# EasyEDA Pro project Example_3D Shell Design.eprj, board 3D Shell Example-B (continued)
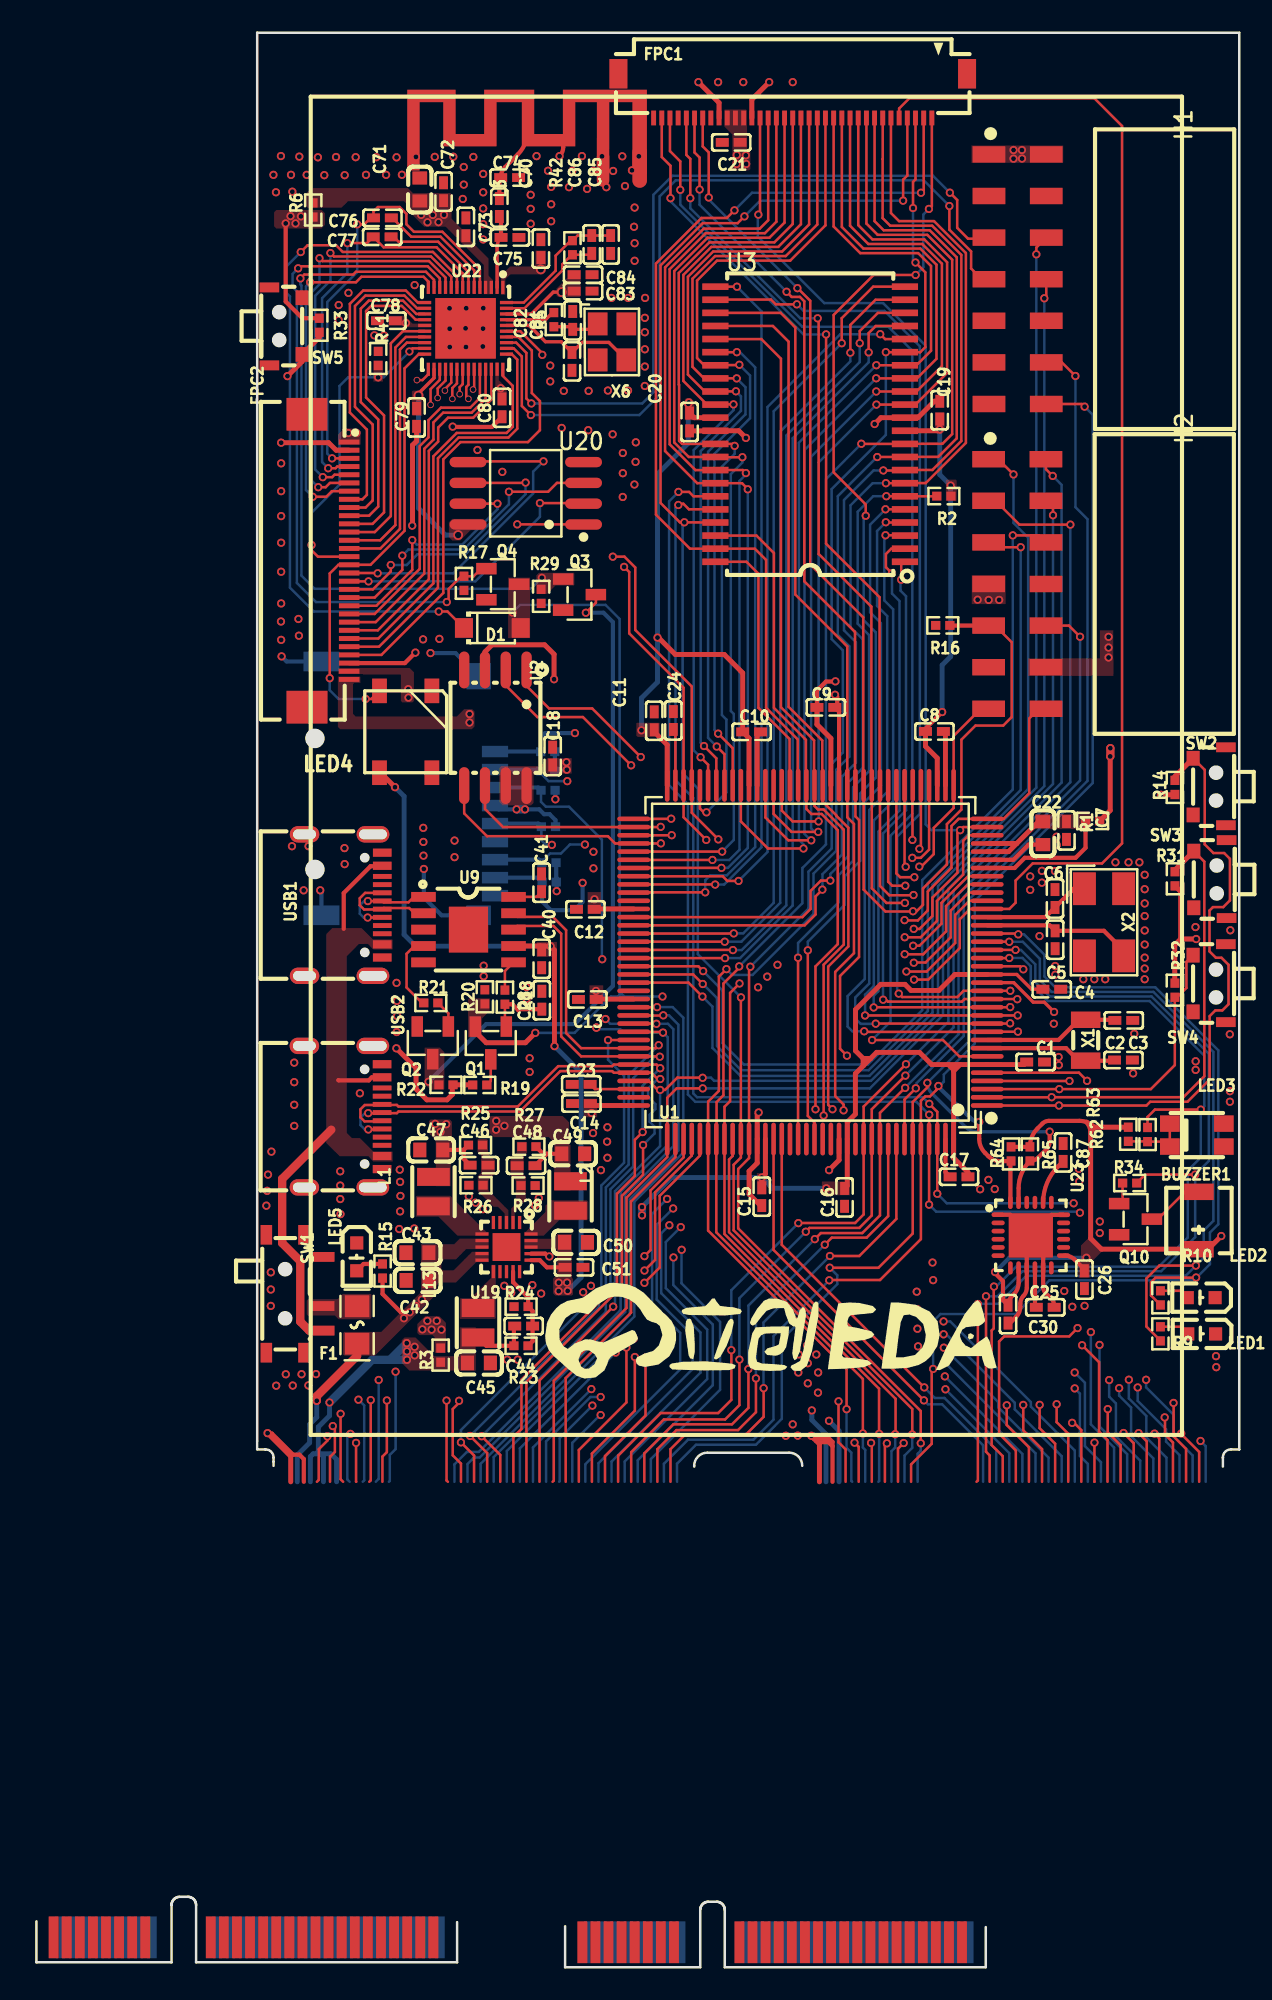
[diagram p0: board, top side]
## Routing (per net, layer and track width the routed paths; a pad name or vN(x,y) marks a point on that pad's centre or on a via; arc(x,y) is an arc through that point) (continued)
FSMC-A17: length 105.9
  Top Layer w0.152: U1.81 36.49,66.11 41.46,66.11 v1(41.47,66.11) ; U3.23 42.8,102.61 v1(42.8,102.61)
  Inner1 w0.152: v1(55.42,38.65) 55.45,38.62 55.51,38.62 55.87,38.98 55.87,54.66 54.71,55.82 54.71,69.16 54.27,69.6 52.76,69.6 52.28,69.12 52.28,67.35 49.02,64.1 44.4,64.1 42.39,66.11 v1(41.47,66.11)
  Bottom Layer w0.152: v1(41.47,66.11) 42.01,66.11 44.3,68.39 44.3,101.11 v1(42.8,102.61) ; v1(55.42,38.65) 55.59,38.65 59.77,34.46 59.77,34.07 62.64,31.2 62.64,29.64
FSMC-A18: length 102.4
  Top Layer w0.152: 41.48,98.61 v1(42.79,98.61) ; v1(40.86,65.63) 36.5,65.63 U1.82
  Inner1 w0.152: v1(40.86,65.63) 42.47,65.63 44.28,63.82 49.14,63.82 52.56,67.24 52.56,68.98 52.9,69.32 54.15,69.32 54.43,69.04 54.43,55.57 55.6,54.4 55.6,39.61 v1(55.42,39.43)
  Bottom Layer w0.152: 63.44,29.64 63.44,31.55 60.75,34.23 60.75,34.51 55.83,39.43 v1(55.42,39.43) ; v1(42.79,98.61) 42.98,98.61 43.91,97.68 43.91,68.4 42.19,66.67 41.16,66.67 40.86,66.37 v1(40.86,65.63)
FSMC-D0: length 125.8
  Top Layer w0.152: FPC1.6 52.21,107.11 52.7,106.61 54.84,106.61 56.78,104.67 56.78,93.07 54.33,90.62 53.08,90.62 ; U1.85 46.8,64.12 47.3,64.62 47.3,65.72 47.93,66.35 v1(48.5,66.35) ; U3.7 v1(51.9,90.61)
  Inner1 w0.152: v1(63.43,35.34) 63.88,35.79 63.88,37.21 61.27,39.82 61.27,50.08 60.73,50.62 60.73,59.42 59.69,60.46 57.96,60.46 57.16,61.26 57.16,69.73 55.6,71.3 51.99,71.3 50.6,69.9 50.6,68.44 v1(48.5,66.35)
  Bottom Layer w0.152: 64.24,29.64 64.24,30.73 63.75,31.22 63.75,35.03 v1(63.43,35.34) ; v1(48.5,66.35) 48.5,66.75 49.59,67.84 49.59,72.33 50.48,73.23 50.48,81.08 49.74,81.83 49.74,89.26 51.09,90.61 v1(51.9,90.61)
FSMC-D1: length 126.9
  Top Layer w0.152: v1(51.74,91.39) 51.73,91.4 51.74,91.39 53.03,91.38 U3.8 ; FPC1.7 51.71,110.41 51.7,110.4 51.7,106.8 52.16,106.34 54.72,106.34 56.51,104.55 56.51,93.19 54.74,91.42 53.08,91.42 ; U1.86 46.94,63.62 47.6,64.28 47.6,65.38 v1(48.02,65.8)
  Inner1 w0.152: v1(63.43,36.32) 63.43,37.22 60.99,39.65 60.99,49.95 60.45,50.49 60.45,59.31 59.58,60.18 57.82,60.18 56.89,61.12 56.89,69.62 55.48,71.02 52.2,71.02 50.88,69.7 50.88,68 48.67,65.8 v1(48.02,65.8)
  Bottom Layer w0.152: v1(51.74,91.39) 51.14,91.39 49.34,89.59 49.34,81.63 50.06,80.9 50.06,73.55 49.21,72.69 49.21,67.93 48.02,66.74 48.02,65.8 v1(48.02,65.8) ; 65.04,29.64 65.04,30.84 64.06,31.82 64.06,35.69 v1(63.43,36.32)
FSMC-D2: length 101.1
  Top Layer w0.152: U3.9 51.37,92.21 v1(51.37,92.21) ; v1(49.5,34.07) 49.5,36.52 41.04,44.98 U1.114 41.04,52.85 41.69,53.51 41.69,60.48 v1(42.16,60.94) ; 53.08,92.22 55.09,92.22 56.23,93.35 56.23,104.41 54.58,106.06 51.76,106.06 51.21,106.61 FPC1.8
  Bottom Layer w0.152: v1(42.16,60.94) 42.51,60.59 43.76,60.59 47.48,64.31 47.48,66.78 48.87,68.17 48.87,73.12 49.67,73.92 49.67,80.65 48.96,81.36 48.96,89.82 51.35,92.21 v1(51.37,92.21) ; v1(49.5,34.07) 49.5,31.71 49.79,31.42 49.79,29.69 49.84,29.64
FSMC-D3: length 99.9
  Top Layer w0.152: 42.94,61.12 42.94,61.03 41.97,60.07 41.97,53.24 41.56,52.82 41.56,50.59 U1.115 41.54,44.87 50.49,35.92 v1(50.49,32.59) ; 42.94,61.12 42.93,61.12 ; 42.94,61.12 42.94,61.13 42.93,61.12 ; 42.93,61.12 42.89,61.16 ; 53.06,93.01 50.41,93.01 v1(50.4,93.02) ; 53.08,93.02 55.35,93.02 55.95,93.61 55.95,104.26 54.43,105.78 51.4,105.78 50.71,106.47 FPC1.9
  Bottom Layer w0.152: v1(42.94,61.11) 46.8,64.97 46.8,67.12 48.24,68.56 48.24,90.86 v1(50.4,93.02) ; 50.64,29.64 50.64,31.59 50.49,31.73 v1(50.49,32.59)
FSMC-D4: length 121.6
  Top Layer w0.152: FPC1.10 50.21,106.37 51.08,105.5 54.25,105.5 55.64,104.11 55.64,97.35 53.71,95.42 53.08,95.42 ; v1(51.32,95.41) U3.13 ; v1(47.78,69.96) 46.2,69.96 45.54,70.62 U1.58
  Inner1 w0.152: v1(47.78,69.96) 47.97,70.15 47.97,70.83 50.95,73.81 64.67,73.81 70.22,68.26 70.22,33.03 v1(71.12,32.13)
  Bottom Layer w0.152: 47.79,69.92 47.79,69.96 ; 47.79,69.96 v1(47.78,69.96) ; 47.79,69.96 47.79,91.88 v1(51.32,95.41) ; 71.44,29.64 71.44,31.82 v1(71.12,32.13)
FSMC-D5: length 123.5
  Top Layer w0.152: v1(47.76,69.32) 46.13,69.32 45.04,70.42 U1.59 ; 53.08,96.22 53.78,96.22 55.32,97.76 55.32,104.02 54.12,105.22 50.82,105.22 49.71,106.33 FPC1.11 ; U3.14 v1(51.31,96.21) ; v1(69.94,32.59) 69.94,32.56 71.04,31.46 71.04,29.64
  Inner1 w0.152: v1(69.94,32.59) 69.94,68.14 64.55,73.53 51.07,73.53 48.25,70.71 48.25,69.66 47.92,69.32 v1(47.76,69.32)
  Bottom Layer w0.152: v1(47.76,69.32) 47.75,69.33 47.53,69.33 47.33,69.54 47.33,92.23 v1(51.31,96.21)
FSMC-D6: length 124.6
  Top Layer w0.152: U3.15 51.31,97.02 v1(51.31,97.02) ; FPC1.12 49.21,106.26 50.52,104.94 54,104.94 54.99,103.95 54.99,98.21 53.8,97.02 53.08,97.02 ; v1(69.47,34.46) 69.48,34.45 69.48,32.41 70.24,31.65 70.24,29.64 ; 44.54,72.17 44.54,70.21 45.93,68.81 v1(47.34,68.81)
  Inner1 w0.152: v1(69.47,34.46) 69.48,34.46 69.48,34.85 69.66,35.03 69.66,68.03 64.44,73.25 51.18,73.25 48.53,70.6 48.53,69.45 47.89,68.81 v1(47.34,68.81)
  Bottom Layer w0.152: v1(47.34,68.81) 47.32,68.81 46.93,69.2 46.93,92.64 v1(51.31,97.02)
FSMC-D7: length 126.7
  Top Layer w0.152: v1(46.86,68.31) 44.69,68.31 43.04,69.96 43.04,72.17 ; FPC1.13 48.71,106.28 50.33,104.66 53.87,104.66 54.65,103.88 54.65,98.7 53.77,97.82 53.08,97.82 ; U3.16 51.32,97.82 ; v1(68.93,33.57) 68.95,33.55 68.95,32.53 69.44,32.04 69.44,29.64
  Inner1 w0.152: v1(46.86,68.31) 47.78,68.31 48.81,69.33 48.81,70.48 51.3,72.97 64.32,72.97 69.38,67.91 69.38,35.15 68.95,34.71 68.95,33.59 v1(68.93,33.57)
  Bottom Layer w0.152: 46.86,68.3 46.88,68.28 46.88,68.55 46.58,68.84 46.58,93.09 v1(51.31,97.82)
FSMC-D8: length 126.9
  Top Layer w0.152: 41.49,97.82 U3.29 ; 41.49,97.82 41.49,97.83 ; 41.49,97.82 40.79,97.82 40.36,98.25 40.36,102.98 41.58,104.2 46.05,104.2 48.21,106.36 FPC1.14 ; 68.64,29.64 68.6,29.68 68.6,32.29 v1(68.31,32.58) ; 41.5,97.82 41.49,97.83 ; 41.49,97.83 42.96,97.83 v1(42.94,97.84) ; v1(41.65,75.32) 42.54,74.43 U1.64
  Inner1 w0.152: v1(41.65,75.32) 42.54,74.43 42.54,70.38 45.07,67.86 47.73,67.86 49.09,69.22 49.09,70.37 51.41,72.69 64.14,72.69 69.09,67.74 69.09,35.25 68.31,34.47 v1(68.31,32.58)
  Bottom Layer w0.152: v1(42.94,97.84) 43.6,97.19 43.6,94.58 41.42,92.41 41.42,75.55 v1(41.65,75.32)
FSMC-D9: length 126.4
  Top Layer w0.152: 41.48,97.02 40.78,97.02 40.08,97.72 40.08,103.1 41.46,104.48 45.78,104.48 47.71,106.41 FPC1.15 ; 41.48,97.02 41.5,97.02 ; 41.48,97.02 42.94,97.02 42.95,97.02 42.95,97.01 v1(42.78,97.01) ; 67.84,29.64 67.84,32.11 v1(67.34,32.61) ; v1(41.56,74.53) 42.04,74.06 U1.65
  Inner1 w0.152: v1(41.56,74.53) 42.04,74.06 42.04,70.49 44.95,67.58 47.84,67.58 49.37,69.1 49.37,70.25 51.53,72.41 64.03,72.41 68.82,67.63 68.82,35.37 67.34,33.89 v1(67.34,32.61)
  Bottom Layer w0.152: v1(41.56,74.53) 41.03,75.06 41.03,92.53 43.32,94.82 43.32,96.47 v1(42.78,97.01)
FSMC-D10: length 126.4
  Top Layer w0.152: 41.5,96.22 42.73,96.22 v1(42.74,96.23) ; FPC1.16 47.21,106.41 45.56,104.76 41.35,104.76 39.8,103.22 39.8,97.25 40.83,96.22 41.5,96.22 ; U1.66 41.54,73.82 v1(40.79,74.57) ; v1(66.42,32.62) 67.04,32 67.04,29.64
  Inner1 w0.152: v1(66.42,32.62) 66.42,33.36 68.54,35.48 68.54,67.51 63.91,72.14 51.64,72.14 49.65,70.14 49.65,68.99 47.96,67.3 44.84,67.3 41.76,70.37 41.76,73.24 41.54,73.46 41.54,73.81 v1(40.79,74.57)
  Bottom Layer w0.152: v1(40.79,74.57) 40.58,74.77 40.58,92.57 43.04,95.03 43.04,95.92 v1(42.74,96.23)
FSMC-D11: length 126.4
  Top Layer w0.152: FPC1.17 46.71,106.43 45.32,105.04 41.23,105.04 39.52,103.33 39.52,96.86 40.96,95.42 41.5,95.42 41.51,95.43 v1(42.59,95.43) ; v1(65.45,34.08) 65.45,32.66 66.24,31.88 66.24,29.64 ; U1.67 41.04,73.42 v1(40.58,73.88)
  Inner1 w0.152: v1(65.45,34.08) 65.48,34.05 66.67,34.05 68.26,35.64 68.26,67.39 63.79,71.86 51.76,71.86 49.92,70.02 49.92,68.87 48.07,67.02 44.72,67.02 41.48,70.26 41.48,73.01 40.61,73.88 v1(40.58,73.88)
  Bottom Layer w0.152: v1(40.58,73.88) 40.15,74.31 40.15,92.64 42.59,95.07 v1(42.59,95.43)
FSMC-D12: length 119.7
  Top Layer w0.152: v1(42.66,92.89) 42.54,93.01 39.45,93.01 39.26,93.2 39.26,96.62 39.24,96.64 39.24,103.45 41.12,105.32 45.09,105.32 46.21,106.44 FPC1.18 ; 65.44,29.64 65.44,32.19 64.92,32.71 64.92,36.94 v1(63.89,37.98) ; U1.68 40.54,70.75 40.77,70.51 40.93,70.51
  Inner1 w0.152: v1(40.94,70.52) 40.94,70.28 44.52,66.7 48.16,66.7 50.26,68.8 50.26,69.96 51.88,71.58 55.71,71.58 57.44,69.85 57.44,61.61 58.3,60.76 59.79,60.76 61.06,59.49 61.06,50.69 61.55,50.19 61.55,40.31 v1(63.89,37.98)
  Bottom Layer w0.152: v1(40.94,70.52) 42.15,71.73 42.15,76.18 41.88,76.46 41.88,91.62 42.66,92.4 v1(42.66,92.89)
FSMC-D13: length 121.1
  Top Layer w0.152: U1.77 41.89,68.12 v1(41.9,68.12) ; FPC1.19 45.71,106.53 44.78,105.6 41,105.6 38.97,103.56 38.97,93.1 39.85,92.21 U3.36 41.49,92.2 v1(43.13,92.2)
  Inner1 w0.152: v1(55.54,35.29) 56.99,36.74 56.99,55.12 55.96,56.15 55.96,67.85 55.94,67.87 55.94,69.51 54.71,70.74 52.32,70.74 51.16,69.58 51.16,67.89 48.48,65.21 45.48,65.21 42.57,68.12 v1(41.9,68.12)
  Bottom Layer w0.152: 59.44,29.64 59.44,31.39 v1(55.54,35.29) ; v1(43.13,92.2) 43.13,91.88 42.42,91.17 42.42,76.7 42.6,76.52 42.6,68.83 v1(41.9,68.12)
FSMC-D14: length 121.9
  Top Layer w0.152: v1(43.34,91.23) 43.16,91.42 41.48,91.42 U3.37 40.26,91.41 38.69,92.99 38.69,103.68 40.89,105.88 44.5,105.88 45.21,106.58 45.21,112.91 ; v1(41.3,67.61) 36.5,67.61 U1.78
  Inner1 w0.152: v1(41.3,67.61) 42.69,67.61 45.37,64.93 48.67,64.93 51.44,67.7 51.44,69.47 52.41,70.44 54.61,70.44 55.61,69.45 55.61,56.11 56.71,55 56.71,37.29 v1(55.5,36.08)
  Bottom Layer w0.152: 60.24,29.64 60.24,31.34 v1(55.5,36.08) ; v1(43.34,91.23) 43.34,91.14 42.95,90.75 42.95,68.23 42.33,67.61 v1(41.3,67.61)
FSMC-D15: length 121.4
  Top Layer w0.152: FPC1.21 44.71,106.67 44.19,106.16 40.77,106.16 38.41,103.79 38.41,92.58 40.37,90.61 U3.38 43.11,90.61 43.47,90.25 v1(43.46,90.24) ; v1(41.85,67.13) 36.49,67.13 U1.79
  Inner1 w0.152: v1(41.85,67.13) 42.78,67.13 45.25,64.65 48.79,64.65 51.72,67.58 51.72,69.35 52.53,70.16 54.5,70.16 55.32,69.34 55.32,56 56.43,54.89 56.43,37.91 55.49,36.97 v1(55.49,36.93)
  Bottom Layer w0.152: 61.04,29.64 61.04,31.38 v1(55.49,36.93) ; v1(41.85,67.13) 42.24,67.13 43.46,68.34 v1(43.46,90.24)
FSMC-NBL0: length 87.5
  Top Layer w0.152: v1(54.54,52.05) 54.54,52.06 v1(54.54,46.56) ; v1(39.22,90.08) 39.87,90.08 40.14,89.81 U3.39
  Inner1 w0.152: v1(63.75,46.07) 63.75,44.43 64.66,43.53 64.66,39.02 v1(64.42,38.78)
  Bottom Layer w0.152: v1(64.42,38.78) 64.42,33.15 65.84,31.73 65.84,29.64 ; v1(54.54,52.05) 53.76,52.84 40.25,52.84 39.8,53.29 39.8,71.02 38.65,72.17 38.65,89.51 v1(39.22,90.08) ; v1(63.75,46.07) 63.69,46.13 54.97,46.13 v1(54.54,46.56)
FSMC-NBL1: length 86.6
  Top Layer w0.152: U3.40 41.47,89.02 39.86,89.02 39.53,89.36 39.29,89.36 v1(39.22,89.28) ; v1(54.55,52.72) 55.04,52.23 U1.142 v1(55.04,47.23)
  Inner1 w0.152: v1(64.95,38) 65.04,38.09 65.04,43.85 64.41,44.48 64.41,46.26 64.02,46.65 v1(63.37,46.65)
  Bottom Layer w0.152: 66.64,29.64 66.64,31.33 64.95,33.02 v1(64.95,38) ; v1(39.22,89.28) 39.04,89.11 39.04,72.48 40.13,71.39 40.13,53.35 40.36,53.12 54.15,53.12 v1(54.55,52.72) ; v1(55.04,47.23) 55.62,46.65 v1(63.37,46.65)
FSMC-NE3: length 45.6
  Top Layer w0.152: v1(46.53,61.64) 46.53,50.57 46.54,50.57 ; R2.2 55,89.81 U3.6 53.06,89.82 v1(51.92,89.82)
  Bottom Layer w0.152: v1(51.92,89.82) 51.12,89.82 50.17,88.87 50.17,82.04 50.87,81.34 50.87,73.02 49.89,72.05 49.89,67.56 49.02,66.68 49.02,65.03 46.53,62.54 v1(46.53,61.64)
FSMC-NE4: length 69.4
  Top Layer w0.152: v1(53.71,103.33) 51.15,103.33 48.71,100.89 48.71,91.28 50.67,89.32 v1(50.67,88.63) ; v1(47.13,62.09) 47.13,51.98 47.54,51.57 U1.127 ; v1(54.53,107.36) 54.71,107.54 FPC1.1
  Bottom Layer w0.152: v1(50.67,88.63) 50.54,88.5 50.54,82.25 51.28,81.51 51.28,72.62 50.32,71.67 50.32,67.55 49.39,66.62 49.39,64.88 47.13,62.62 v1(47.13,62.09) ; v1(54.53,107.36) 54.19,107.02 54.19,103.8 v1(53.71,103.33)
FSMC-NOE: length 105
  Top Layer w0.152: v1(43.04,59.22) 43.04,59.21 43.04,49.44 42.59,49 42.59,45 53.51,34.09 v1(53.51,32.53) ; v1(52.95,107.86) 52.95,109.15 53.21,109.4 FPC1.4 ; v1(43.26,106.9) 42.84,106.49 40.71,106.49 38.13,103.91 38.13,89.41 39.31,88.23 39.58,88.22 U3.41
  Bottom Layer w0.152: v1(43.26,106.9) 44.22,107.86 v1(52.95,107.86) ; 53.04,29.64 53.04,31.24 53.51,31.71 v1(53.51,32.53) ; v1(39.58,88.23) 39.48,88.12 39.48,72.9 40.41,71.97 40.41,61.85 43.05,59.22
FSMC-NWE: length 94.9
  Top Layer w0.152: v1(43.62,61.09) 43.54,61.01 U1.119 43.54,49.41 42.87,48.74 42.87,45.11 54.03,33.96 v1(54.03,32) ; v1(53.7,104.09) 54.3,103.49 54.3,98.92 54,98.61 v1(51.9,98.61) ; v1(53.56,107.41) 53.56,109.01 53.71,109.17 FPC1.3
  Bottom Layer w0.152: v1(51.9,98.61) 51.9,93.57 48.58,90.25 48.58,81.1 49.27,80.41 49.27,74.17 48.59,73.49 48.59,68.31 47.16,66.89 47.16,64.64 v1(43.62,61.09) ; 53.84,29.64 53.84,31.35 54.03,31.54 v1(54.03,32) ; v1(53.7,104.09) 53.56,104.24 v1(53.56,107.41)
GPIO0: length 19.4
  Top Layer w0.152: U22.23 22.98,98.85 v1(22.79,98.65) ; FPC2.15 17.2,86.13 16.81,86.52 v1(16.81,86.84)
  Bottom Layer w0.152: v1(22.79,98.65) 21.21,97.08 19.04,97.08 18.52,96.55 18.52,90.52 16.81,88.81 v1(16.81,86.84)
  vias: v1(20.88,97.07)
GPIO2: length 16.2
  Top Layer w0.152: FPC2.14 21.02,86.63 22.21,87.82 22.21,98.77 22.63,99.19 U22.22
GPIO4: length 27.7
  Top Layer w0.152: LED4.4 20.46,77.44 v1(20.12,77.44) ; 23.72,98.49 23.36,98.49 22.49,97.62 22.49,87.71 20.41,85.63 FPC2.16 18.45,85.63 17.92,85.1 v1(17.92,78.71)
  Bottom Layer w0.152: v1(17.92,78.71) 17.92,77.97 18.46,77.44 v1(20.12,77.44)
GPIO5: length 20.2
  Top Layer w0.152: FPC2.22 20.66,82.63 23.41,85.38 23.41,92.88 23.95,93.41 23.95,94.46 24.72,95.23 26.5,95.23 27.09,95.82 U22.34
GPIO12: length 19.2
  Top Layer w0.152: FPC2.11 20.53,88.13 21.24,88.83 21.24,94.75 20.14,95.85 20.14,101.13 20.45,101.44 22.32,101.44 23.17,100.6 U22.18
GPIO13: length 15.9
  Top Layer w0.152: U22.20 22.39,99.89 21.65,99.15 21.65,88.61 20.67,87.63 FPC2.12
GPIO14: length 19
  Top Layer w0.152: U22.17 23.21,100.95 22.4,101.76 20.31,101.76 19.82,101.27 19.82,95.57 20.88,94.5 20.88,89.19 20.32,88.63 19.11,88.63
GPIO15: length 16.1
  Top Layer w0.152: U22.21 22.58,99.54 21.93,98.9 21.93,88.06 21,87.13 FPC2.13
GPIO18: length 20.9
  Top Layer w0.152: U22.35 27.44,95.77 26.59,94.92 24.85,94.92 24.25,94.32 24.25,93.27 23.69,92.71 23.69,85.1 20.73,82.13 FPC2.23
GPIO19: length 23.7
  Top Layer w0.152: U22.38 28.49,97.16 29.1,96.56 29.1,94.06 28.72,93.68 25.68,93.68 24.25,92.25 24.25,84.5 20.89,81.13 FPC2.25
GPIO21: length 29.1
  Top Layer w0.152: 28.72,99.54 29.44,99.54 30.27,98.71 30.27,96.12 30.76,95.62 30.76,93.85 30.03,93.12 25.91,93.12 24.86,92.07 24.86,83.91 21.07,80.13 FPC2.27
GPIO22: length 25.4
  Top Layer w0.152: FPC2.26 20.93,80.63 24.53,84.23 24.53,92.14 25.79,93.4 28.84,93.4 29.38,93.94 29.38,98.16 29.04,98.49 28.72,98.49
GPIO23: length 21.5
  Top Layer w0.152: FPC2.24 20.86,81.63 23.97,84.75 23.97,92.58 24.54,93.16 24.54,94.01 25.15,94.61 26.69,94.61 27.79,95.72 U22.36
GPIO25: length 23.6
  Top Layer w0.152: U22.14 23.94,102.93 23.65,103.22 19.86,103.22 19.52,102.88 v1(16.72,102.88) ; v1(16.88,89.78) 17.71,89.78 18.05,90.13 FPC2.7
  Bottom Layer w0.152: v1(16.72,102.88) 16.47,102.63 16.47,90.19 v1(16.88,89.78)
GPIO26: length 18.5
  Top Layer w0.152: U22.15 23.3,101.64 22.57,102.38 19.96,102.38 19.15,101.57 19.15,94.93 20.19,93.89 20.19,89.9 19.92,89.63 FPC2.8
GPIO27: length 18.8
  Top Layer w0.152: U22.16 23.26,101.29 22.48,102.07 20.1,102.07 19.46,101.43 19.46,95.28 20.54,94.19 20.54,89.56 20.11,89.13 FPC2.9
GPIO32: length 42.3
  Top Layer w0.152: Q4.1 27.17,85.4 26.71,84.93 25.96,84.93 25.18,84.16 25.18,83.47 v1(25.07,83.36) ; U22.12 24.64,103.12 23.91,103.86 16.11,103.86 v1(15.99,103.73)
  Bottom Layer w0.152: v1(15.99,103.73) 15.65,103.39 15.65,102.59 15.91,102.33 15.91,84.52 17.08,83.36 v1(25.07,83.36)
GPIO33: length 42.5
  Top Layer w0.152: v1(16.13,103.12) 16.36,103.35 19.35,103.35 19.52,103.52 23.8,103.52 24.29,103.03 U22.13
  Bottom Layer w0.152: v1(16.13,103.12) 16.13,102.75 16.19,102.69 16.19,84.97 17,84.17 30.21,84.17 v1(30.88,84.84)
GPIO34: length 24.6
  Top Layer w0.152: FPC2.5 18.21,91.13 18.06,90.98 v1(17.5,90.98) ; v1(17.96,104.67) 18.17,104.46 24.1,104.46 25.34,103.21 U22.10
  Bottom Layer w0.152: v1(17.96,104.67) 17.96,102.99 17.03,102.05 17.03,91.45 v1(17.5,90.98)
GPIO35: length 25.2
  Top Layer w0.152: FPC2.6 17.93,90.63 17.67,90.37 v1(17.22,90.37) ; U22.11 24.99,103.17 23.98,104.18 17.47,104.18 v1(17.29,104.35)
  Bottom Layer w0.152: v1(17.29,104.35) 17.29,102.76 16.75,102.21 16.75,90.84 v1(17.22,90.37)
IIC-SCL: length 98.7
  Top Layer w0.152: v1(48.47,42.71) 48.47,42.71 51.44,42.71 53.54,44.8 U1.139 53.54,52.83 54.43,53.72 v1(54.43,54) ; H1.12 62.65,97.99 v1(63.48,97.16)
  Top Layer w0.254: 60.01,46.69 60.01,47.56 arc(60.19,48.47) R65.1 arc(60.97,49.28) 61.21,49.44 61.69,49.93 arc(61.85,50.16) 61.9,50.43 v1(61.9,51.02)
  Bottom Layer w0.152: v1(48.47,42.71) 48.93,42.25 48.93,41.71 45.54,38.32 45.54,33.48 43.96,31.9 40.29,31.9 39.14,30.75 39.14,29.64 ; v1(63.48,97.16) 63.48,89.15 64.21,88.41 64.21,72.44 57.02,65.25 57.02,56.59 v1(54.43,54)
  Bottom Layer w0.203: v1(54.43,54) arc(54.5,53.66) 54.69,53.38 56.78,51.28 arc(57.08,51.09) 57.43,51.02 61.9,51.02 v1(61.9,51.02) arc(61.88,50.99) 61.85,51
IIC-SDA: length 93.2
  Top Layer w0.152: H1.14 63.88,95.45 v1(64.04,95.29) ; v1(55.11,53.81) 55.11,53.7 54.97,53.57 54.97,53.55 54.59,53.17 54.3,53.17 54.04,52.9 U1.140 54.04,44.46 51.54,41.96 48.46,41.96 v1(48.44,41.94)
  Top Layer w0.254: 59.51,46.69 59.51,49.13 arc(59.52,49.18) R64.1 arc(59.54,49.22) 59.53,49.22 58.87,49.22 arc(58.49,49.3) 58.16,49.52 57.96,49.72 arc(57.69,50.12) 57.6,50.58 v1(57.6,51.61)
  Bottom Layer w0.152: 55.14,53.73 55.14,53.74 ; 55.14,53.74 55.14,53.78 55.44,54.07 55.44,54.51 57.33,56.4 57.33,65.1 64.53,72.31 64.53,94.79 v1(64.04,95.29) ; 55.14,53.73 55.13,53.73 ; 38.34,29.64 38.34,30.74 39.81,32.21 43.8,32.21 45.03,33.43 45.03,38.53 v1(48.44,41.94)
  Bottom Layer w0.254: 55.13,53.78 v1(55.11,53.81) ; 55.13,53.78 55.14,53.75 ; 55.13,53.78 55.14,53.78 55.14,53.75 ; 55.14,53.75 55.14,53.73 ; 55.14,53.75 55.13,53.73 57.09,51.82 arc(57.33,51.67) v1(57.6,51.61)
KEY-DOWN: length 56.3
  Top Layer w0.152: SW3.1 71.35,67.51 71.35,54.4 70.07,53.12 v1(62.02,53.12) 62.02,53.12 U1.2
  Top Layer w0.3: R31.1 69.56,67 SW3.1
  Inner1 w0.152: v1(62.02,53.12) 63.14,53.12 66.15,50.12 v1(66.15,35.36)
  Bottom Layer w0.152: 68.24,29.64 68.24,31.07 66.88,32.43 66.88,34.18 66.15,34.91 v1(66.15,35.36)
KEY-OK: length 46.4
  Top Layer w0.152: U1.3 v1(62.49,53.62) 68.08,53.62 69.55,55.08 69.55,59.09 70.26,59.79 70.26,61.39 70.67,61.8
  Inner1 w0.152: v1(62.49,53.62) 63.28,53.62 66.74,50.16 v1(66.74,35.87)
  Bottom Layer w0.152: v1(66.74,35.87) 66.74,34.73 67.81,33.66 67.81,32.34 69.04,31.12 69.04,29.64
KEY-UP: length 64.7
  Top Layer w0.152: U1.1 58.09,52.61 v1(62.47,52.61) 67.82,52.61 68.04,52.84 70.32,52.84 71.68,54.2 71.68,58.07 72.03,58.42 72.45,58.42 72.83,58.8 72.83,61.21 72.4,61.64 72.06,61.64 71.67,62.03 71.67,64.52 71.88,64.73 72.51,64.73 72.92,65.14 72.92,67.68 72.56,68.03 71.91,68.03 71.38,68.56 71.38,73.11 SW2.1
  Top Layer w0.3: SW2.1 69.55,72.7 R14.1
  Inner1 w0.152: v1(65.54,35.85) 65.54,50.16 63.09,52.61 v1(62.47,52.61)
  Bottom Layer w0.152: v1(65.54,35.85) 65.54,34.84 65.95,34.43 65.95,32.42 67.44,30.93 67.44,29.64
LCD-BL: length 119.7
  Top Layer w0.152: U1.35 56.62,69.62 v1(56.43,69.43) ; v1(56.43,69.43) 56.36,69.5 ; v1(56.43,69.43) 56.27,69.26 56.27,66.83 54.74,65.3 54.74,64.19 53.95,63.4 53.6,63.4 v1(53.6,63.4) ; 17.94,29.64 17.94,31.16 18.23,31.46 18.23,32.92 v1(18.11,33.04) ; FPC1.22 44.21,107.11 v1(44.11,107.01)
  Inner1 w0.152: v1(53.6,63.4) 53.6,63.4 52.67,63.4 45.13,55.86 45.13,47.72 44.06,46.66 44.06,43.47 38.21,37.61 38.21,37.05 37.55,36.39 33.55,36.39 31,33.85 19.29,33.85 18.49,33.04 v1(18.11,33.04)
  Bottom Layer w0.152: v1(44.11,107.01) 44.07,106.98 44.07,105.67 48.13,101.61 51.73,101.61 54.33,99.01 54.33,69.78 54.68,69.43 v1(56.43,69.43)
LED0: length 63.6
  Top Layer w0.152: 57.44,29.64 57.52,29.72 v1(57.52,40.5) ; R9.1 68.67,38.26 67.81,39.12 67.81,42.06 68.6,42.84 v1(70.84,42.84) ; U1.21 59.43,62.62 v1(59.43,62.61)
  Bottom Layer w0.152: v1(57.52,40.5) 57.53,40.51 58.77,40.51 60.48,42.22 70.21,42.22 v1(70.84,42.84) 71.32,43.32 71.32,44.98 71.91,45.57 71.91,55.89 68.24,59.55 62.02,59.55 61.3,60.27 61.3,61.57 60.26,62.61 v1(59.43,62.61)
LED1: length 64.4
  Top Layer w0.152: R10.1 68.09,41.02 68.09,41.82 68.37,42.1 70.84,42.1 v1(70.85,42.11) ; U1.22 59.88,63.12 59.95,63.04 59.96,63.04 v1(59.99,63.07) ; 53.44,29.64 53.44,30.7 54.69,31.96 54.69,36.45 v1(54.78,36.53)
  Bottom Layer w0.152: v1(59.99,63.07) 60.34,63.07 61.58,61.82 61.58,60.49 62.24,59.83 68.36,59.83 72.21,55.98 72.21,45.37 71.7,44.86 71.7,42.93 70.88,42.11 v1(70.85,42.11) 70.68,41.94 61.88,41.94 59.83,39.88 55.23,39.88 54.78,39.43 v1(54.78,36.53)
NRF-CE: length 56.9
  Top Layer w0.152: U1.91 40.44,61.12 v1(40.73,60.82) ; v1(59.65,87.43) 61.25,87.43 H2.6
  Bottom Layer w0.152: v1(40.73,60.82) 41.91,59.64 41.91,56.42 43.22,55.12 50.79,55.12 54.12,58.44 54.12,66.38 59.65,71.91 v1(59.65,87.43)
NRF-CS: length 56.4
  Top Layer w0.152: v1(40.71,60.04) 40.12,60.62 U1.92 ; H2.5 58.47,86.7 v1(60.13,86.7)
  Bottom Layer w0.152: v1(60.13,86.7) 60.13,71.88 54.46,66.21 54.46,58.39 50.84,54.77 43.06,54.77 41.58,56.25 41.58,59.18 40.72,60.04 v1(40.71,60.04)
NRF-IRQ: length 61.3
  Top Layer w0.152: v1(40.69,59.27) 39.84,60.12 U1.93 ; v1(59.69,91.15) 58.76,92.08 H2.1
  Bottom Layer w0.152: v1(59.69,91.15) 59.69,88.19 60.59,87.29 60.59,71.94 54.75,66.1 54.75,58.28 50.89,54.42 43.01,54.42 41.3,56.13 41.3,58.66 v1(40.69,59.27)
PA0: length 67.7
  Top Layer w0.152: U1.34 56.95,69.12 56.62,68.78 56.62,66.71 55.02,65.11 55.02,63.88 54.02,62.89 53.05,62.89 v1(53.05,62.89) ; v1(17.78,32.41) 17.78,32.15 17.25,31.63 17.25,29.76 17.14,29.64
  Inner1 w0.152: v1(17.78,32.41) 18.34,32.41 19.49,33.57 31.37,33.57 33.7,35.9 37.87,35.9 38.69,36.72 38.69,37.43 44.34,43.09 44.34,46.48 45.41,47.55 45.41,55.74 52.55,62.89 53.04,62.89 v1(53.05,62.89)
PA2: length 76.9
  Top Layer w0.152: H2.14 61.24,76.84 60.65,76.25 60.65,71.68 59.09,70.12 U1.36 56.34,70.12 55.9,69.68 55.9,67.13 54.46,65.68 54.46,64.53 53.85,63.92 53.06,63.92 v1(53.04,63.93) ; v1(18.58,33.79) 18.58,29.8 18.74,29.64
  Inner1 w0.152: v1(18.58,33.79) 18.92,34.12 30.89,34.12 33.51,36.75 37.41,36.75 37.88,37.22 37.88,37.92 43.79,43.83 43.79,46.86 44.85,47.93 44.85,55.97 52.79,63.92 53.02,63.92 v1(53.04,63.93)
PA3: length 76.6
  Top Layer w0.152: v1(19.53,32.02) 19.53,29.65 19.54,29.64 ; v1(53.94,67.2) 54.06,67.2 54.82,67.97 54.82,69.57 56.04,70.78 U1.37 56.04,75.18 57.69,76.84 H2.13
  Inner1 w0.152: v1(53.94,67.2) 54.15,66.99 54.15,58.78 51.53,56.16 48.19,56.16 47.08,55.05 47.08,46.71 46.02,45.64 46.02,42.23 42,38.21 42,35.84 39.14,32.98 20.49,32.98 v1(19.53,32.02)
PA4: length 64.9
  Top Layer w0.152: 20.34,29.64 20.42,29.73 v1(20.42,34.63) ; v1(53.51,67.74) 54.03,67.74 54.54,68.24 54.54,72.17